# EasyEDA Pro project AgOopenHardwareMicro.eprj, board PCB_AIO v4.5 Micro AMP 2024-02-05
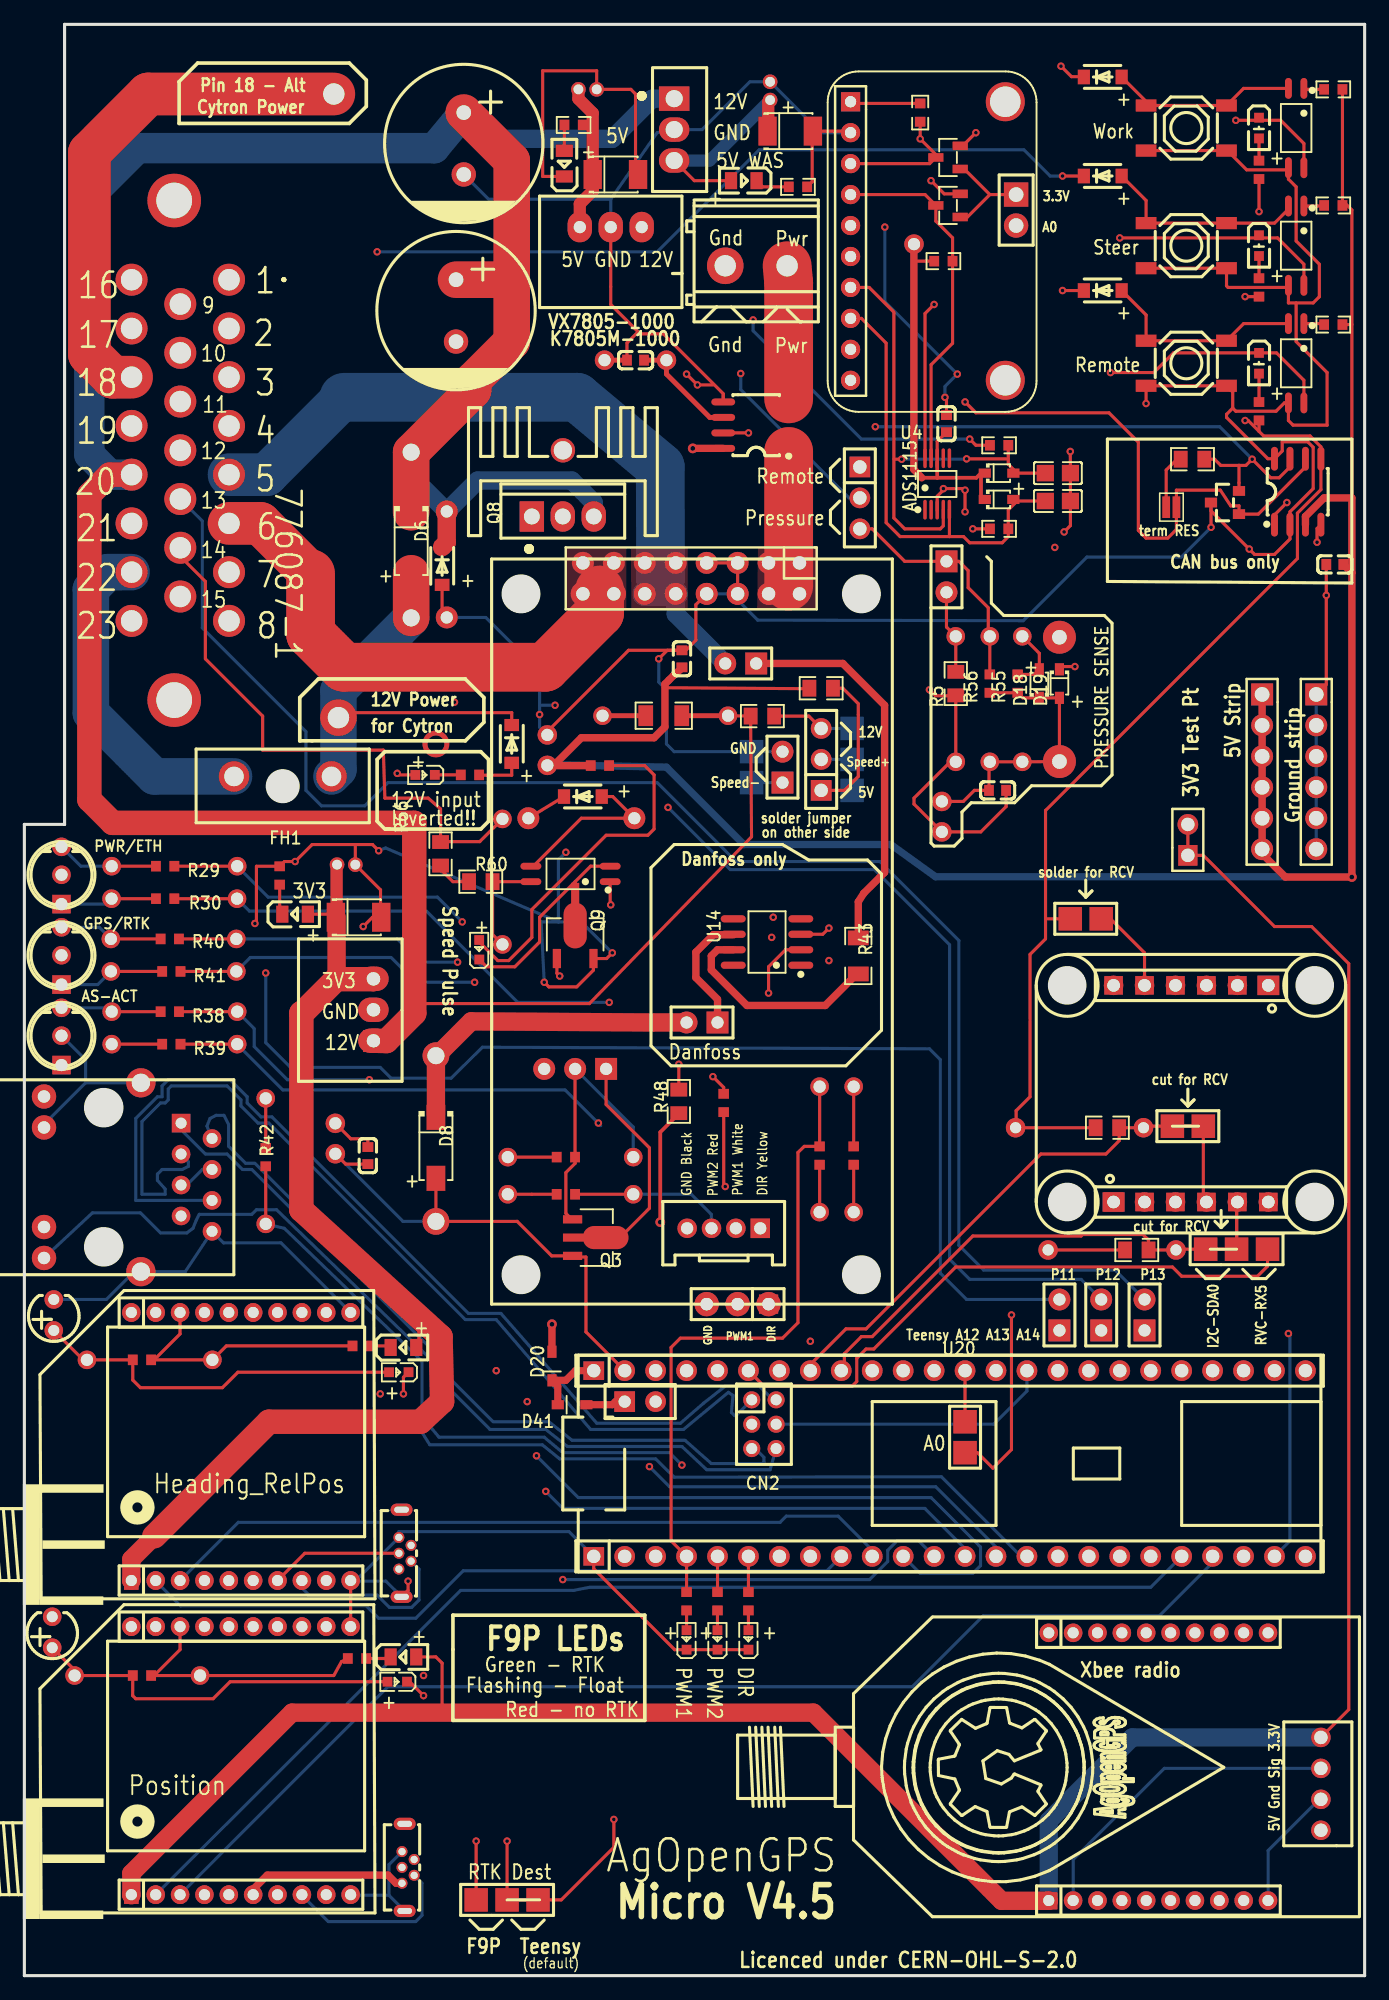
[diagram p10: board, top side]
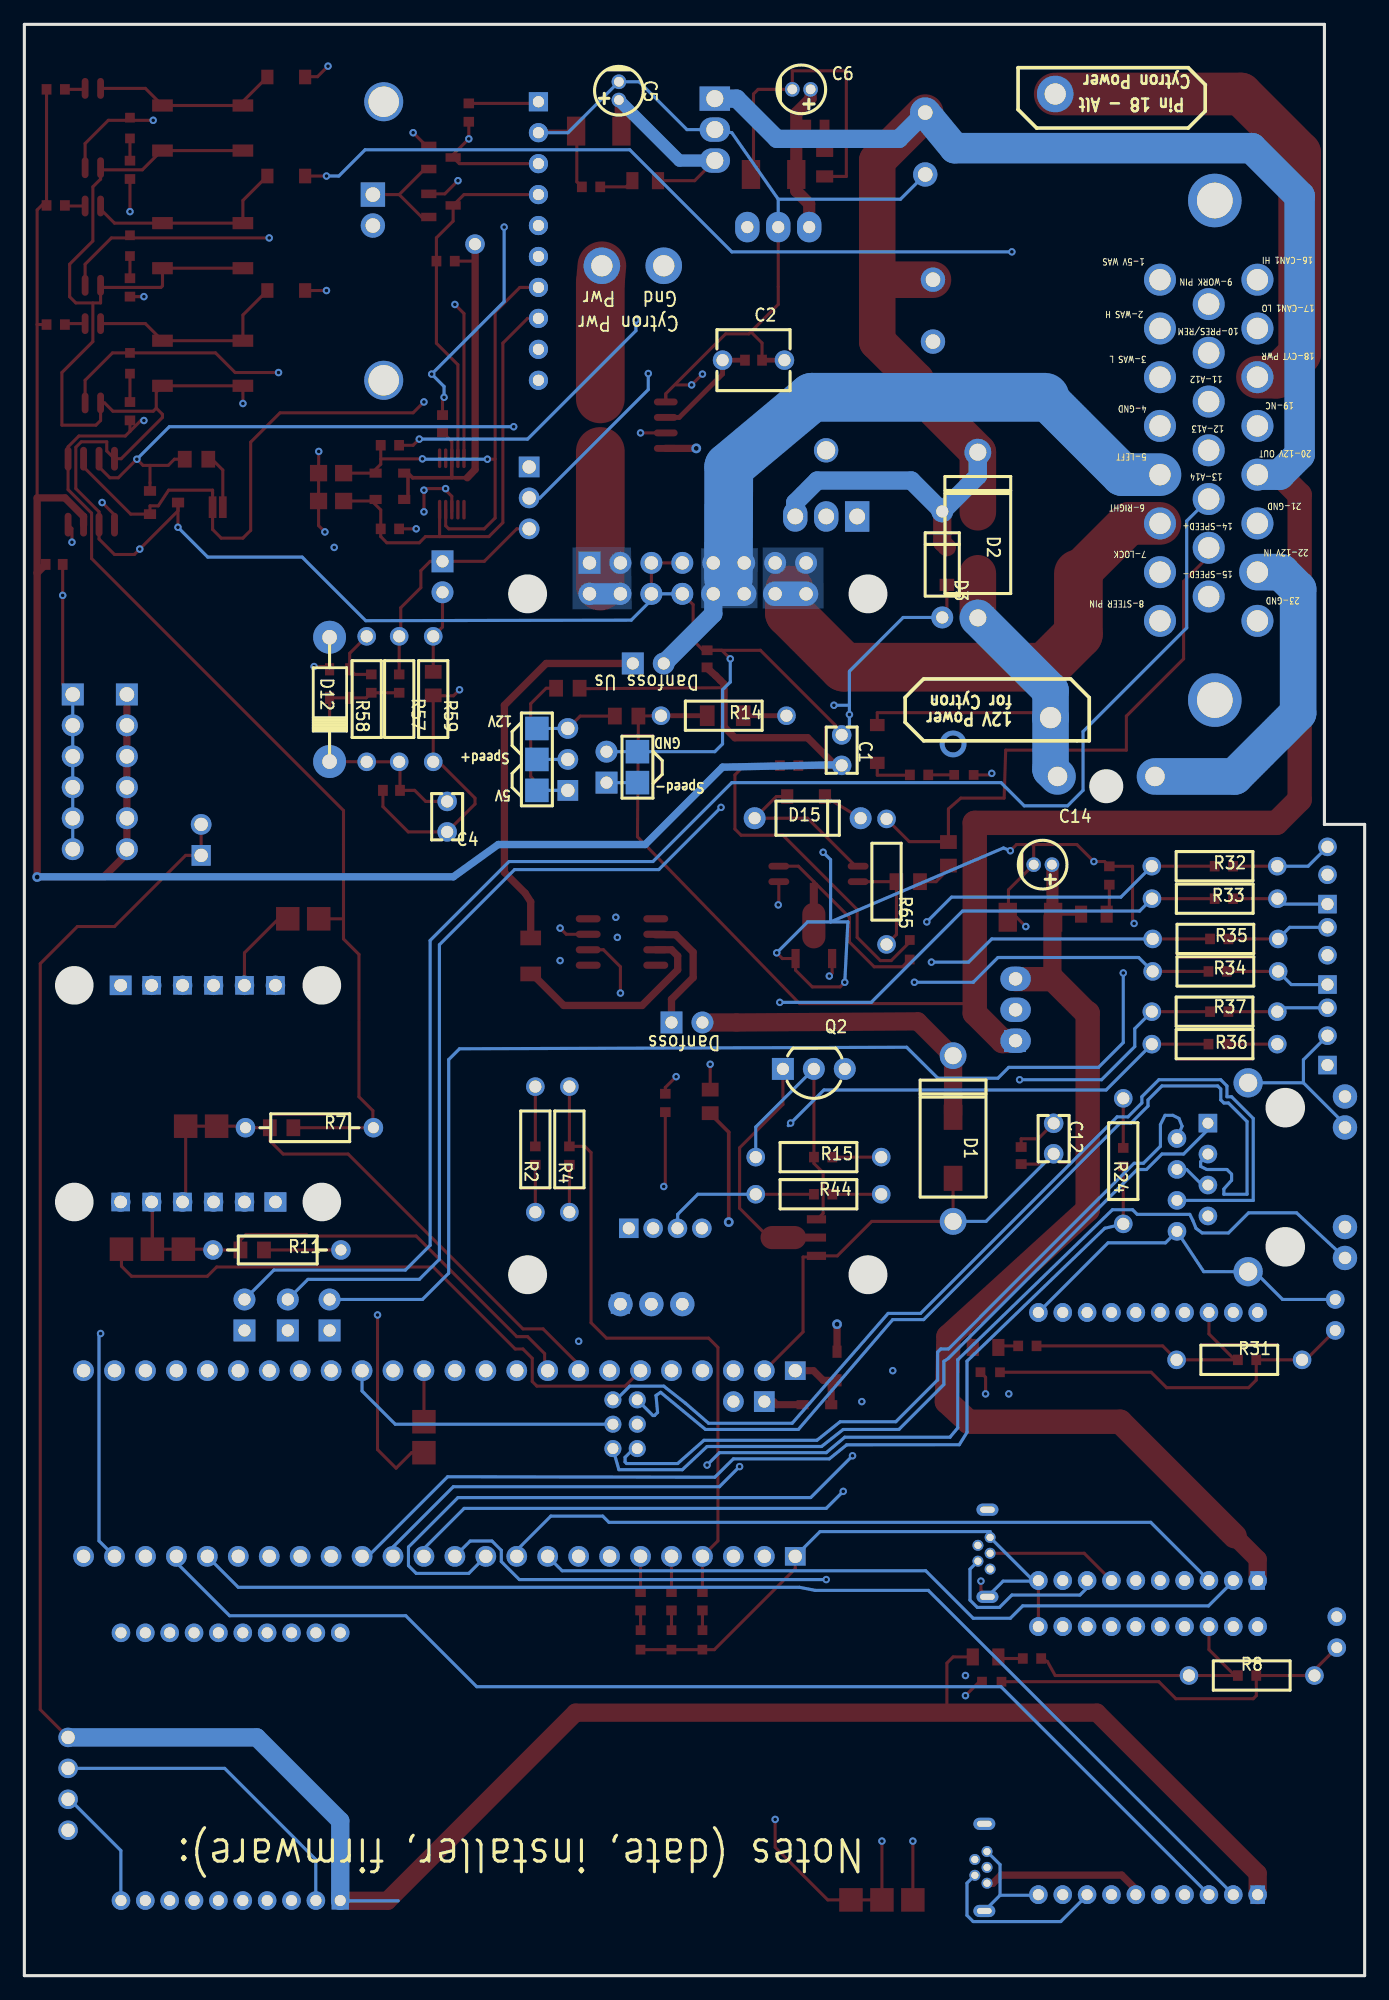
[diagram p11: board, bottom side, seen from below]

Outline 110.01 x 160.14 mm; copper layers: Top Layer, Inner1, Inner2, Bottom Layer. Coordinates in mm from the lower left corner of the outline.
Outline path: 0,94.48 3.3,94.48 3.3,160.14 110.01,160.14 110.01,0 0,0 0,94.48
Stack: Top Layer 0.035mm / Dielectric1 0.48mm PP er 4.5 / Inner1 0.035mm / Dielectric2 0.48mm FR4 er 4.5 / Inner2 0.035mm / Dielectric3 0.48mm PP er 4.5 / Bottom Layer 0.035mm

## Design rules (mm)
spacing Default (default): track to track 0.2, other pairs 0 to 0.2
spacing 5v: track to track 0.2, other pairs 0 to 0.2
spacing 12v: track to track 0.3, other pairs 0 to 0.3
spacing sec: track to track 0.2, other pairs 0 to 0.2
track width Default (default): min 0.254, default 0.254, max 25.4
track width 5v: min 0.6, default 0.6, max 25.4
track width 12v: min 1.5, default 1.5, max 25.4
track width sec: min 0.5, default 0.5, max 25.4
differential pair differentialPair (default): width min 0.127, default 0.254, max 2.54; gap min 0.152, default 0.152
via Default (default): diameter min 0.61, default 0.61, max 100.025; hole min 0.305, default 0.305, max 59.995
via 5v: diameter min 0.8, default 0.8, max 100.025; hole min 0.4, default 0.4, max 59.995
via 12v: diameter min 1, default 1, max 100.025; hole min 0.6, default 0.6, max 59.995
via sec: diameter min 0.8, default 0.8, max 100.025; hole min 0.4, default 0.4, max 59.995
net 5V_WAS uses 5v
net 5V2 uses 5v
net 5VUSB1 uses 5v
net 5VUSB uses 5v
net +12V_BOARD uses 12v
net LOCK uses 12v
net +15VCYT uses 12v, gge462106
net 12V_CYTRON uses 12v, gge462106(1)
net LEFT uses 12v
net RIGHT uses 12v
net +12V_IN uses 12v
net GND uses gge1424176(1)
pour e402 uses gge1424176
pour e403 uses gge1059532
pour e695 uses gge1069402
pour e1032 uses gge1069393
pour e1779 uses gge462106
pour e1780 uses gge462106(1)
pour e1781 uses gge1059532(1)
pour e1782 uses gge1424176(1)

## Placement (name value [footprint] x y rotation side)
AS-ACT  DY-339URUYGW/SN  [footprint_04ce]  3.05 77.08 90 top
C1  0.1uF  [footprint_9b0b]  42.93 100.58 90 bottom
C2  1nF  [footprint_89b2]  50.16 132.58 180 bottom
C3  100nF  [footprint_19ac]  79.88 97.27 180 top
C4  0.1uF  [footprint_9b0b]  75.31 95.12 90 bottom
C5  22uF  [footprint_a80e]  61.21 154.68 90 bottom
C6  22uF  [footprint_a80e]  46.23 154.81 0 bottom
C7  10nF  [footprint_89fb]  84.84 121.02 0 top
C8  100uF  [footprint_7bcb]  27.43 86.86 0 top
C9  100uF  [footprint_7bcb]  48.51 147.82 0 top
C10  100uF  [footprint_7bcb]  62.87 151.38 0 top
C11  100nF_CAN  [footprint_19ac]  107.57 115.82 0 top
C12  0.1uF  [footprint_9b0b]  25.53 68.7 90 bottom
C14  22uF  [footprint_a80e]  26.42 91.18 0 bottom
C15  1000uF  [footprint_6613]  36.07 150.36 270 top
C16  100nF  [footprint_19ac]  75.69 127.37 90 top
C17  1000uF  [footprint_6613]  35.43 136.64 270 top
C19  100nF  [footprint_19ac]  53.97 108.07 270 top
C20  1nF  [footprint_19ac]  50.16 132.58 180 top
C23  10nF  [footprint_89fb]  84.84 123.31 180 top
C26  100nF  [footprint_19ac]  28.19 67.3 90 top
CN1  CYTRON CABLE  [footprint_3aea]  57.4 61.33 0 top
CN2  A2005HWV-2X3P  [footprint_9724]  60.71 45.26 270 top
D1  1N5401  [footprint_8dbb]  33.78 68.7 270 bottom
D2  1N5401  [footprint_8dbb]  31.75 118.23 270 bottom
D3  1N4004  [footprint_00b7]  34.67 115.82 90 bottom
D4  SM4007PL  [footprint_5765]  88.52 147.69 0 top
D5  PESD1CAN,215  [footprint_eecc]  98.55 120.9 0 top
D6  SS54_C22452  [footprint_14cd]  31.75 117.59 270 top
D7  SM4007PL  [footprint_5765]  34.29 115.69 270 top
D8  SS54_C22452  [footprint_14cd]  33.78 67.94 270 top
D9  SM4007PL  [footprint_5765]  88.52 138.3 0 top
D11  SM4007PL  [footprint_5765]  88.52 155.82 0 top
D12  ZENER  [footprint_46d5]  84.96 104.64 0 bottom
D13  SM4007PL  [footprint_5765]  40 101.08 270 top
D14  SM4007PL  [footprint_5765]  45.85 96.77 0 top
D15  1N4004  [footprint_00b7]  45.72 94.99 180 bottom
D16  1N5819WS  [footprint_5a89]  80.01 121.15 0 top
D17  1N5819WS  [footprint_5a89]  80.01 123.31 0 top
D18  1N5819WS  [footprint_5a89]  83.31 106.04 90 top
D19  1N5819WS  [footprint_5a89]  84.96 106.04 270 top
D20  1N5819WS  [footprint_5976]  43.31 50.03 90 top
D41  1N5819WS  [footprint_5976]  44.96 46.86 0 top
FH1  178.6764.0001  [footprint_57e4]  21.21 98.42 0 top
GPS/RTK  DY-339URUYGW/SN  [footprint_04ce]  3.05 83.69 90 top
H1  HEADER_2mm  [footprint_0abc]  17.78 32.43 0 top
H2  Jumper  [footprint_61f6]  84.96 54.22 90 top
H3  Ground  [footprint_dfc0]  106.04 98.8 270 top
H4  4-20ma  [footprint_61f6]  75.69 114.8 270 top
H5  Remote or Pressure Input  [footprint_1175]  68.58 121.28 270 top
H6  Jumper  [footprint_61f6]  88.39 54.22 90 top
H7  HEADER_2mm  [footprint_0abc]  17.78 54.42 0 top
H8  HEADER_3PINS  [footprint_1b4c]  58.55 55.11 180 top
H9  HEADER_2mm_XBEE  [footprint_0abc]  93.09 6.16 0 top
H10  HEADER_2mm_XBEE  [footprint_0abc]  93.09 28.14 0 top
H11  HEADER_2mm  [footprint_0abc]  17.78 6.64 0 top
H12  HEADER_2mm  [footprint_0abc]  17.78 28.65 0 top
H13  HEADER_6PINS  [footprint_c888]  95.76 81.27 180 top
H14  HEADER_6PINS  [footprint_c888]  95.76 63.49 0 top
H15  Jumper  [footprint_61f6]  91.95 54.22 90 top
H18  22850102ANG1SYA02  [footprint_2104]  81.41 144.9 270 top
H19  Speed-  [footprint_61f6]  62.23 99.18 90 top
H20  VUSB  [footprint_6ba6]  50.55 47.11 0 top
H21  68000-102HLF  [footprint_61f6]  55.63 78.22 180 top
H22  Danfoss Us  [footprint_61f6]  58.8 107.69 180 top
H24  5V  [footprint_dfc0]  101.6 98.8 270 top
J1  HEADER_Cytron 2x8  [footprint_5f34]  54.74 114.67 180 top
J2  AMPSEAL 23 - 776087-1  [footprint_1ad4]  16.8 139.18 270 top
J3  3V3  [footprint_4a10]  95.5 93.21 90 top
J4  Speed+ Pullup  [footprint_1175]  65.41 99.81 90 top
JP1  SLC  [footprint_8437]  95.5 69.72 0 top
JP2  SPARKFUN-JUMPERS_JUMPER-SMT_2_NC_PASTE_NO-SILK  [footprint_26ea]  94.23 121.02 0 top
JP3  RVC Mode  [footprint_8437]  87.12 86.73 180 top
JP4  A0  [footprint_8437]  77.22 44.19 270 top
JP5  RVC Mode  [footprint_cc47]  59.69 99.18 90 bottom
LED1  RTK_STAT_1  [footprint_1af2]  2.41 54.22 90 top
LED2  RTK_STAT_2  [footprint_1af2]  2.29 28.19 90 top
LED3  RTK  [footprint_6589]  31.11 51.55 0 top
LED4  5V  [footprint_6589]  44.32 148.71 90 top
LED5  RTK  [footprint_6589]  31.11 26.15 0 top
LED7  5V WAS  [footprint_6589]  59.06 147.31 180 top
LED8  3V3  [footprint_6589]  22.22 87.11 0 top
LED9  PWM2_LED  [footprint_985f]  56.9 27.55 90 top
LED10  PWM1_LED  [footprint_985f]  54.36 27.55 90 top
LED11  DIR_LED  [footprint_985f]  59.44 27.55 90 top
LED12  SPEED_LED  [footprint_985f]  37.34 84.19 90 top
LED15  0603_RED  [footprint_985f]  30.73 49.52 180 top
LED16  0603_RED  [footprint_985f]  30.61 24.12 180 top
LED17  0603_RED  [footprint_985f]  32.89 98.54 180 top
LED_REMOTE  Remote  [footprint_6b63]  101.35 132.33 270 top
LED_STEER  Steer  [footprint_6b63]  101.35 141.98 270 top
LED_WORK  Work  [footprint_6b63]  101.35 151.63 270 top
NOREF  -  [Pad_e5261]  25.78 103.24 0 top
NOREF#2  -  [Pad_e5277]  25.4 154.42 0 top
NOREF#3  -  [Pad_e5263]  28.65 79.27 90 top
NOREF#4  -  [Pad_e5282]  73.03 142.11 90 top
NOREF#5  -  [Pad_e5262]  28.65 81.81 90 top
NOREF#6  -  [Pad_e5264]  28.65 76.73 90 top
P2  RTK Radio  [footprint_4317]  106.43 15.74 90 top
P4  ADS1115  [footprint_5939]  75.44 142.49 270 top
PWR/ETH  DY-339URUYGW/SN  [footprint_04ce]  3.05 90.29 90 top
Q2  2N2222A  [footprint_269b]  45.21 74.41 0 bottom
Q3  D882_C9634  [footprint_89dc]  46.35 60.57 180 top
Q4  2N7002  [footprint_df55]  75.82 149.22 0 top
Q5  2N7002  [footprint_df55]  75.82 145.28 0 top
Q8  IRF5305PBF  [footprint_eaf4]  44.2 119.75 90 top
Q9  D882_C9634  [footprint_acbf]  45.21 84.83 270 top
R1  270Ω  [footprint_eb8a]  107.44 145.28 0 top
R2  1k  [footprint_b4b1]  68.07 67.81 270 bottom
R3  270Ω  [footprint_eb8a]  107.44 135.5 0 top
R4  1k  [footprint_b4b1]  65.28 67.81 270 bottom
R5  200Ω  [footprint_dc35]  76.45 106.04 90 top
R6  1kΩ  [footprint_4e14]  27.31 26.03 0 top
R7  2.2K  [footprint_a246]  86.61 69.59 180 bottom
R8  1k  [footprint_b4b1]  9.27 24.63 0 bottom
R10  1kΩ  [footprint_4e14]  20.95 90.29 270 top
R11  2.2K  [footprint_a246]  89.28 59.56 180 bottom
R12  2.2kΩ  [footprint_dc35]  88.9 69.59 0 top
R13  2.2kΩ  [footprint_dc35]  91.31 59.56 0 top
R14  10k  [footprint_b4b1]  52.61 103.4 0 bottom
R15  1k  [footprint_b4b1]  44.83 67.18 0 bottom
R16  270Ω  [footprint_eb8a]  107.44 154.81 0 top
R17  5.1kΩ  [footprint_76e4]  63.5 146.8 180 top
R18  1kΩ  [footprint_4e14]  36.58 98.54 0 top
R19  1kΩ  [footprint_4e14]  9.65 50.54 0 top
R20  1kΩ  [footprint_4e14]  101.35 128.39 270 top
R21  1kΩ  [footprint_4e14]  57.4 71.62 270 top
R22  5.1kΩ  [footprint_76e4]  75.44 140.71 0 top
R23  2kΩ  [footprint_4e14]  47.24 99.31 0 top
R24  1k  [footprint_b4b1]  19.81 66.85 270 bottom
R25  1kΩ  [footprint_4e14]  44.45 67.18 0 top
R26  1kΩ  [footprint_4e14]  9.65 24.63 0 top
R27  1kΩ  [footprint_4e14]  56.9 30.73 90 top
R28  1kΩ  [footprint_4e14]  54.36 30.73 90 top
R29  1kΩ  [footprint_4e14]  11.56 91.05 0 top
R30  1kΩ  [footprint_4e14]  11.56 88.38 0 top
R31  1k  [footprint_b4b1]  10.29 50.54 0 bottom
R32  1k  [footprint_b4b1]  12.32 91.05 180 bottom
R33  1k  [footprint_b4b1]  12.31 88.38 180 bottom
R34  1k  [footprint_b4b1]  12.25 82.42 180 bottom
R35  1k  [footprint_b4b1]  12.25 85.08 180 bottom
R36  1k  [footprint_b4b1]  12.32 76.45 180 bottom
R37  1k  [footprint_b4b1]  12.32 79.11 180 bottom
R38  1kΩ  [footprint_4e14]  11.94 79.11 0 top
R39  1kΩ  [footprint_4e14]  12.06 76.45 0 top
R40  1kΩ  [footprint_4e14]  11.94 85.08 0 top
R41  1kΩ  [footprint_4e14]  12.06 82.42 0 top
R42  1kΩ  [footprint_4e14]  19.81 67.18 270 top
R43  1kΩ  [footprint_e2a5]  68.45 83.69 270 top
R44  1k  [footprint_b4b1]  44.83 64.13 180 bottom
R46  1kΩ  [footprint_4e14]  44.45 64.13 180 top
R47  10kΩ  [footprint_e2a5]  52.48 103.4 0 top
R48  200Ω  [footprint_dc35]  53.72 71.75 90 top
R49  1kΩ  [footprint_4e14]  68.07 67.3 90 top
R50  1kΩ  [footprint_4e14]  65.28 67.3 90 top
R51  1kΩ  [footprint_4e14]  59.44 30.73 90 top
R52  1kΩ  [footprint_4e14]  101.35 148.2 270 top
R53  1kΩ  [footprint_4e14]  101.35 138.55 270 top
R54  1kΩ  [footprint_4e14]  27.69 51.68 0 top
R55  12kΩ  [footprint_4e14]  81.53 106.04 270 top
R56  6.2kΩ  [footprint_4e14]  79.25 106.04 90 top
R57  6.2k  [footprint_b4b1]  79.25 104.77 90 bottom
R58  12k  [footprint_b4b1]  81.91 104.77 270 bottom
R59  200Ω  [footprint_b4b1]  76.45 104.77 90 bottom
R60  120Ω  [footprint_dc35]  37.47 89.78 0 top
R61  5.1kΩ  [footprint_76e4]  45.09 151.88 0 top
R62  2.2kΩ  [footprint_dc35]  65.41 105.66 0 top
R63  5.1kΩ  [footprint_76e4]  73.53 152.9 270 top
R64  120Ω  [footprint_dc35]  95.88 124.45 0 top
R65  330  [footprint_b4b1]  39.24 89.78 90 bottom
R66  200Ω  [footprint_dc35]  34.16 92.07 270 top
R71  2.2kΩ  [footprint_dc35]  60.58 103.37 0 top
R73  1.5kΩ  [footprint_76e4]  80.01 118.74 180 top
R74  1.5kΩ  [footprint_76e4]  80.01 125.6 180 top
REMOTE_SW  TS-1187A-B-A-B  [footprint_86d5]  95.38 132.33 0 top
REMOTEOPTO  EL3H7(B)(TA)-G  [footprint_7a44]  104.39 132.33 270 top
RJ1  HR913550A  [footprint_28a5]  8.51 65.52 90 top
SJ1  JUMPER-PAD-3-NO  [footprint_9d65]  100.77 59.62 0 top
SJ2  JUMPER-PAD-3-NO  [footprint_9d65]  40.89 6.22 0 top
SJ3  JUMPER-PAD-3-NO  [footprint_e36f]  67.94 98.54 270 bottom
SPEEDPULSEOPTO  EL3H7(B)(TA)-G  [footprint_7a44]  44.83 90.42 180 top
STEER_SW  TS-1187A-B-A-B  [footprint_86d5]  95.38 141.98 0 top
STEEROPTO  EL3H7(B)(TA)-G  [footprint_7a44]  104.39 141.98 270 top
U1  ACS712ELCTR-05B-T  [footprint_ae0f]  60.07 127.25 90 top
U2  Cytron MD13S  [footprint_8577]  54.74 85.46 180 top
U3  K7803M-1000R3  [footprint_a0e4]  28.7 79.24 90 top
U4  ADS1115IDGSR  [footprint_a15c]  74.93 122.42 0 top
U5  Teensy/IMU Power  [footprint_8be4]  48.13 143.5 180 top
U6  MC7805CTG  [footprint_f649]  53.34 151.5 0 top
U11  Dual-Left  [footprint_247a]  17.78 43.43 90 top
U13  15*10.5*21  [footprint_eabb]  44.21 125.18 0 top
U14  TC4427AEOA713  [footprint_b85c]  60.96 84.83 90 top
U15  Ardfruit BNO085  [footprint_7c61]  100.84 83.81 0 top
U16  HEADER_ADS-MCP6002  [footprint_5ace]  67.82 142.36 270 top
U17  MCP2562-E/SN  [footprint_ae0f]  104.52 121.79 0 top
U18  Single/Dual-Right  [footprint_3ab3]  17.78 17.65 90 top
U20  TEENSY 4.1  [footprint_e0fd]  46.74 34.41 0 top
U23  Cytron Pwr  [footprint_8b36]  60.07 140.33 180 top
U24  LR_RADIO_XBEE_SOCKET  [footprint_2c55]  93.09 17.14 90 top
U29  H_TEENSY  [footprint_5514]  75.95 34.41 0 top
U30  H_TEENSY  [footprint_5514]  75.95 49.65 0 top
USB2  MICRO 180°JB  [footprint_5333]  31.5 8.88 270 top
USB3  MICRO 180°JB  [footprint_5333]  31.24 34.66 270 top
WORK_SW  TS-1187A-B-A-B  [footprint_86d5]  95.38 151.63 0 top
WORKOPTO  EL3H7(B)(TA)-G  [footprint_7a44]  104.39 151.63 270 top

## Footprints (pads in the part's own frame, mm; a bottom-side part is the same pattern mirrored in y, then rotated)
footprint_0abc
  round 1.524 hole 0.914: 1(-9,0) 2(-7,0) 3(-5,0) 4(-3,0) 5(-1,0) 6(1,0) 7(3,0) 8(5,0) 9(7,0) 10(9,0)
footprint_00b7
  round 1.8 hole 1: 1(-4.35,0) 2(4.35,0)
footprint_1ad4
  round 2.625 hole 1.755x1.75: 1(0,0) 2(4,0) 3(8,0) 4(12,0) 5(16,0) 6(20,0) 7(24,0) 8(28,0) 9(2,-4) 10(6,-4) 11(10,-4) 12(14,-4) 13(18,-4) 14(22,-4) 15(26,-4) 16(0,-8) 17(4,-8) 18(8,-8) 19(12,-8) 20(16,-8) 21(20,-8) 22(24,-8) 23(28,-8)
  round 4.395 hole 2.93x2.93: MH1(-6.5,-4.5) MH2(34.5,-4.5)
footprint_1af2
  round 1.524 hole 0.9: 1(-1.27,0) 2(1.27,0)
footprint_1b4c
  rect 1.575x1.575 hole 1.02: 1(-2.54,0)
  round 1.575 hole 1.02: 2(0,0) 3(2.54,0)
footprint_2c55
  rect 1.423x1.423 hole 0.701: 1(-10.998,9.005)
  round 1.423 hole 0.701: 2(-10.998,6.997) 3(-10.998,4.991) 4(-10.998,2.985) 5(-10.998,1.004) 6(-10.998,-1.004) 7(-10.998,-3.01) 8(-10.998,-5.016) 9(-10.998,-6.997) 10(-10.998,-9.005) 11(10.998,-9.005) 12(10.998,-6.997) 13(10.998,-5.016) 14(10.998,-3.01) 15(10.998,-1.004) 16(10.998,1.004) 17(10.998,2.985) 18(10.998,4.991) 19(10.998,6.997) 20(10.998,9.005)
footprint_3ab3
  rect 1.524x1.2 hole 0.75: 1(-11,9)
  oval 1.524x1.2 hole 0.75: 2(-11,7) 3(-11,5) 4(-11,3) 5(-11,1) 6(-11,-1) 7(-11,-3) 8(-11,-5) 9(-11,-7) 10(-11,-9) 11(11,-9) 12(11,-7) 13(11,-5) 14(11,-3) 15(11,-1) 16(11,1) 17(11,3) 18(11,5) 19(11,7) 20(11,9)
footprint_3aea
  rect 1.6x1.6 hole 1: 1(3,0)
  round 1.6 hole 1: 2(1,0) 3(-1,0) 4(-3,0)
footprint_4a10
  rect 1.7x1.575 hole 1.1: 1(-1.27,0)
  round 1.7 hole 1.1: 2(1.27,0)
footprint_04ce
  rect 1.524x1.524 hole 1: 1(-2.349,0)
  round 1.524 hole 1: 2(0.059,0) 3(2.349,0)
footprint_4e14
  rect 0.806x0.864 smd: 1(-0.753,0) 2(0.753,0)
footprint_5a89
  rect 1x0.75 smd: 1(-1.173,0) 2(1.173,0)
footprint_5ace
  rect 1.575x1.575 hole 0.889: 1(-11.43,0)
  round 1.575 hole 0.889: 2(-8.89,0) 3(-6.35,0) 4(-3.81,0) 5(-1.27,0) 6(1.27,0) 7(3.81,0) 8(6.35,0) 9(8.89,0) 10(11.43,0)
footprint_5f34
  rect 1.8x1.8 hole 1.1: 1(-8.89,-1.27)
  round 1.8 hole 1.1: 2(-8.89,1.27) 3(-6.35,-1.27) 4(-6.35,1.27) 5(-3.81,-1.27) 6(-3.81,1.27) 7(-1.27,-1.27) 8(-1.27,1.27) 9(1.27,-1.27) 10(1.27,1.27) 11(3.81,-1.27) 12(3.81,1.27) 13(6.35,-1.27) 14(6.35,1.27) 15(8.89,-1.27) 16(8.89,1.27)
footprint_6b63
  rect 0.8x0.8 smd: 1(0.851,0) 2(-0.851,0)
footprint_6ba6
  rect 1.7x1.7 hole 1: 1(-1.27,0)
  round 1.7 hole 1: 2(1.27,0)
footprint_7a44
  oval 1.71x0.56 smd: 1(-3.255,0.635) 2(-3.255,-0.635) 3(3.255,-0.635) 4(3.255,0.635)
footprint_7bcb
  rect 1.506x2.376 smd: 1(-1.861,0) 2(1.861,0)
footprint_7c61
  rect 1.524x1.524 hole 1.016: 1(-11.43,-20.32) 2(-8.89,-20.32) 3(-6.35,-20.32) 4(-3.81,-20.32) 5(-1.27,-20.32) 6(1.27,-20.32) 7(1.27,-2.54) 8(-1.27,-2.54) 9(-3.81,-2.54) 10(-6.35,-2.54) 11(-8.89,-2.54) 12(-11.43,-2.54)
footprint_8b36
  round 3 hole 1.75: 1(-2.54,0) 2(2.54,0)
footprint_8be4
  oval 2x2.5 hole 1: 1(-2.54,0) 2(0,0) 3(2.54,0)
footprint_8dbb
  round 2.2 hole 1.4: 1(-6.8,0) 2(6.8,0)
footprint_9b0b
  round 1.6 hole 1: 1(-1.25,0) 2(1.25,0)
footprint_9d65
  rect 1.931x1.931 smd: 1(1.27,0) 2(-1.27,0) 3(-3.81,0)
footprint_14cd
  rect 2.062x1.539 smd: 1(2.503,0) 2(-2.503,0)
footprint_19ac
  rect 0.8x0.9 smd: 1(-0.7,0) 2(0.7,0)
footprint_26ea
  custom 0.635x1.778 smd: 1(-0.508,0.254) 2(0.33,-0.254)
footprint_28a5
  rect 1.524x1.524 hole 0.9: 1(4.44,-4.355)
  round 1.524 hole 0.9: 2(3.18,-6.895) 3(1.9,-4.355) 4(0.64,-6.895) 5(-0.64,-4.355) 6(-1.9,-6.895) 7(-3.18,-4.355) 8(-4.44,-6.895)
  round 2 hole 1.02: 9(6.625,6.895) 10(4.085,6.895) 11(-4.085,6.895) 12(-6.625,6.895)
  round 2.4 hole 1.5: 13(7.75,-1.055) 14(-7.75,-1.055)
footprint_46d5
  round 2.7 hole 1.2: 1(0,-5.2) 2(0,5)
footprint_57e4
  round 2.5 hole 1.6: 1(-4,0) 2(4,0)
footprint_61f6
  rect 1.8x1.8 hole 1: 1(-1.27,0)
  round 1.8 hole 1: 2(1.27,0)
footprint_76e4
  rect 0.806x0.864 smd: 1(-0.753,0) 2(0.753,0)
footprint_86d5
  rect 1.7x1 smd: 1(-3.3,1.85) 2(3.3,1.85) 3(-3.3,-1.85) 4(3.3,-1.85)
footprint_89b2
  round 1.6 hole 1: 1(-2.54,0) 2(2.54,0)
footprint_89dc
  rect 1.575x0.672 smd: 1(1.357,-1.5) 3(1.357,1.5)
  custom 5.377x1.9 smd: 2(-1.357,0)
footprint_89fb
  rect 1.41x1.35 smd: 1(-1.03,0) 2(1.03,0)
footprint_247a
  rect 1.524x1.2 hole 0.75: 1(-11,9)
  oval 1.524x1.2 hole 0.75: 2(-11,7) 3(-11,5) 4(-11,3) 5(-11,1) 6(-11,-1) 7(-11,-3) 8(-11,-5) 9(-11,-7) 10(-11,-9) 11(11,-9) 12(11,-7) 13(11,-5) 14(11,-3) 15(11,-1) 16(11,1) 17(11,3) 18(11,5) 19(11,7) 20(11,9)
footprint_269b
  rect 1.8x1.8 hole 1: 1(2.54,0)
  round 1.8 hole 1: 2(0,0) 3(-2.54,0)
footprint_985f
  rect 0.8x0.8 smd: 1(-0.799,-0.004) 2(0.799,0.004)
footprint_1175
  rect 1.7x1.7 hole 1.1: 1(-2.54,0)
  round 1.7 hole 1.1: 2(0,0) 3(2.54,0)
footprint_2104
  rect 2x2 hole 1.2: 1(-1.27,0)
  round 2 hole 1.2: 2(1.27,0)
footprint_4317
  round 1.6 hole 1.1: 1(-3.81,0) 2(-1.27,0) 3(1.27,0) 4(3.81,0)
footprint_5333
  round 0.9 hole 0.6: 1(1.3,-0.5) 2(0.65,0.5) 3(0,-0.5) 4(-0.65,0.5) 5(-1.3,-0.5)
  oval 1x1.8 hole 0.5x1.2: 6(-3.575,-0.28) 7(3.575,-0.28)
footprint_5514
  rect 1.7x1.524 hole 1.1: 1(-29.21,0)
  round 1.7 hole 1.1: 2(-26.67,0) 3(-24.13,0) 4(-21.59,0) 5(-19.05,0) 6(-16.51,0) 7(-13.97,0) 8(-11.43,0) 9(-8.89,0) 10(-6.35,0) 11(-3.81,0) 12(-1.27,0) 13(1.27,0) 14(3.81,0) 15(6.35,0) 16(8.89,0) 17(11.43,0) 18(13.97,0) 19(16.51,0) 20(19.05,0) 21(21.59,0) 22(24.13,0) 23(26.67,0) 24(29.21,0)
footprint_5765
  rect 1x1.2 smd: 1(-1.55,0) 2(1.55,0)
footprint_5939
  round 1.524 hole 0.914: 1(-11.303,-7.62) 2(-8.763,-7.62) 3(-6.223,-7.62) 4(-3.683,-7.62) 5(-1.143,-7.62) 6(1.397,-7.62) 7(3.937,-7.62) 8(6.477,-7.62) 9(9.017,-7.62) 10(11.557,-7.62)
  round 3.2 hole 2.499: P$1(-11.303,5.08) P$2(11.557,5.08)
footprint_5976
  rect 1x0.75 smd: 1(-1.173,0) 2(1.173,0)
footprint_6589
  rect 1x1.399 smd: 1(1.05,0) 2(-1.05,0)
footprint_6613
  round 2 hole 1.2: 1(-2.54,0) 2(2.54,0)
footprint_8437
  rect 1.931x1.931 smd: 1(1.27,0) 2(-1.27,0)
footprint_8577
  round 2 hole 1: 1(-6.35,30.353) 2(-3.81,30.353) 3(-1.27,30.353)
  round 1.75 hole 1: 4(-8.89,-27.94) 5(-3.81,-27.94) 6(3.81,-27.94) 7(8.89,-27.94) 8(-6.35,-27.94) 9(-1.27,-27.94) 10(6.35,-27.94) 11(1.27,-27.94)
footprint_9724
  round 1.4 hole 0.9: 1(-2,-1) 2(-2,1) 3(0,-1) 4(0,1) 5(2,-1) 6(2,1)
footprint_a0e4
  rect 1.8x1.8 hole 1: 1(-2.54,0)
  round 1.8 hole 1: 2(0,0) 3(2.54,0)
footprint_a15c
  oval 0.28x1.62 smd: 1(-1,-2.11) 2(-0.5,-2.11) 3(0,-2.11) 4(0.5,-2.11) 5(1,-2.11) 6(1,2.11) 7(0.5,2.11) 8(0,2.11) 9(-0.5,2.11) 10(-1,2.11)
footprint_a80e
  round 1.2 hole 0.8: 1(-0.75,0) 2(0.75,0)
footprint_a246
  round 1.6 hole 0.914: 1(-5.25,0) 2(5.25,0)
footprint_acbf
  rect 1.575x0.672 smd: 1(1.357,-1.5) 3(1.357,1.5)
  custom 5.377x1.9 smd: 2(-1.356,0)
footprint_ae0f
  oval 0.569x1.95 smd: 1(-1.905,-2.705) 2(-0.635,-2.705) 3(0.635,-2.705) 4(1.905,-2.705) 5(1.905,2.705) 6(0.635,2.705) 7(-0.635,2.705) 8(-1.905,2.705)
footprint_b4b1
  round 1.524 hole 1: 1(-5.15,0) 2(5.15,0)
footprint_b85c
  oval 0.588x2.045 smd: 1(-1.905,-2.772) 2(-0.635,-2.772) 3(0.635,-2.772) 4(1.905,-2.772) 5(1.905,2.772) 6(0.635,2.772) 7(-0.635,2.772) 8(-1.905,2.772)